# EasyEDA Pro project 智能母版V4.eprj, schematic Schematic1

## Sheets
1 电源: Create Date: 2024-02-19; Page Name: 电源; Project Name: 智能母版V4; Schematic Name: Schematic1; Update Date: 2024-07-11; Company: 嘉立创EDA; Page Size: A4; Version: V1.0
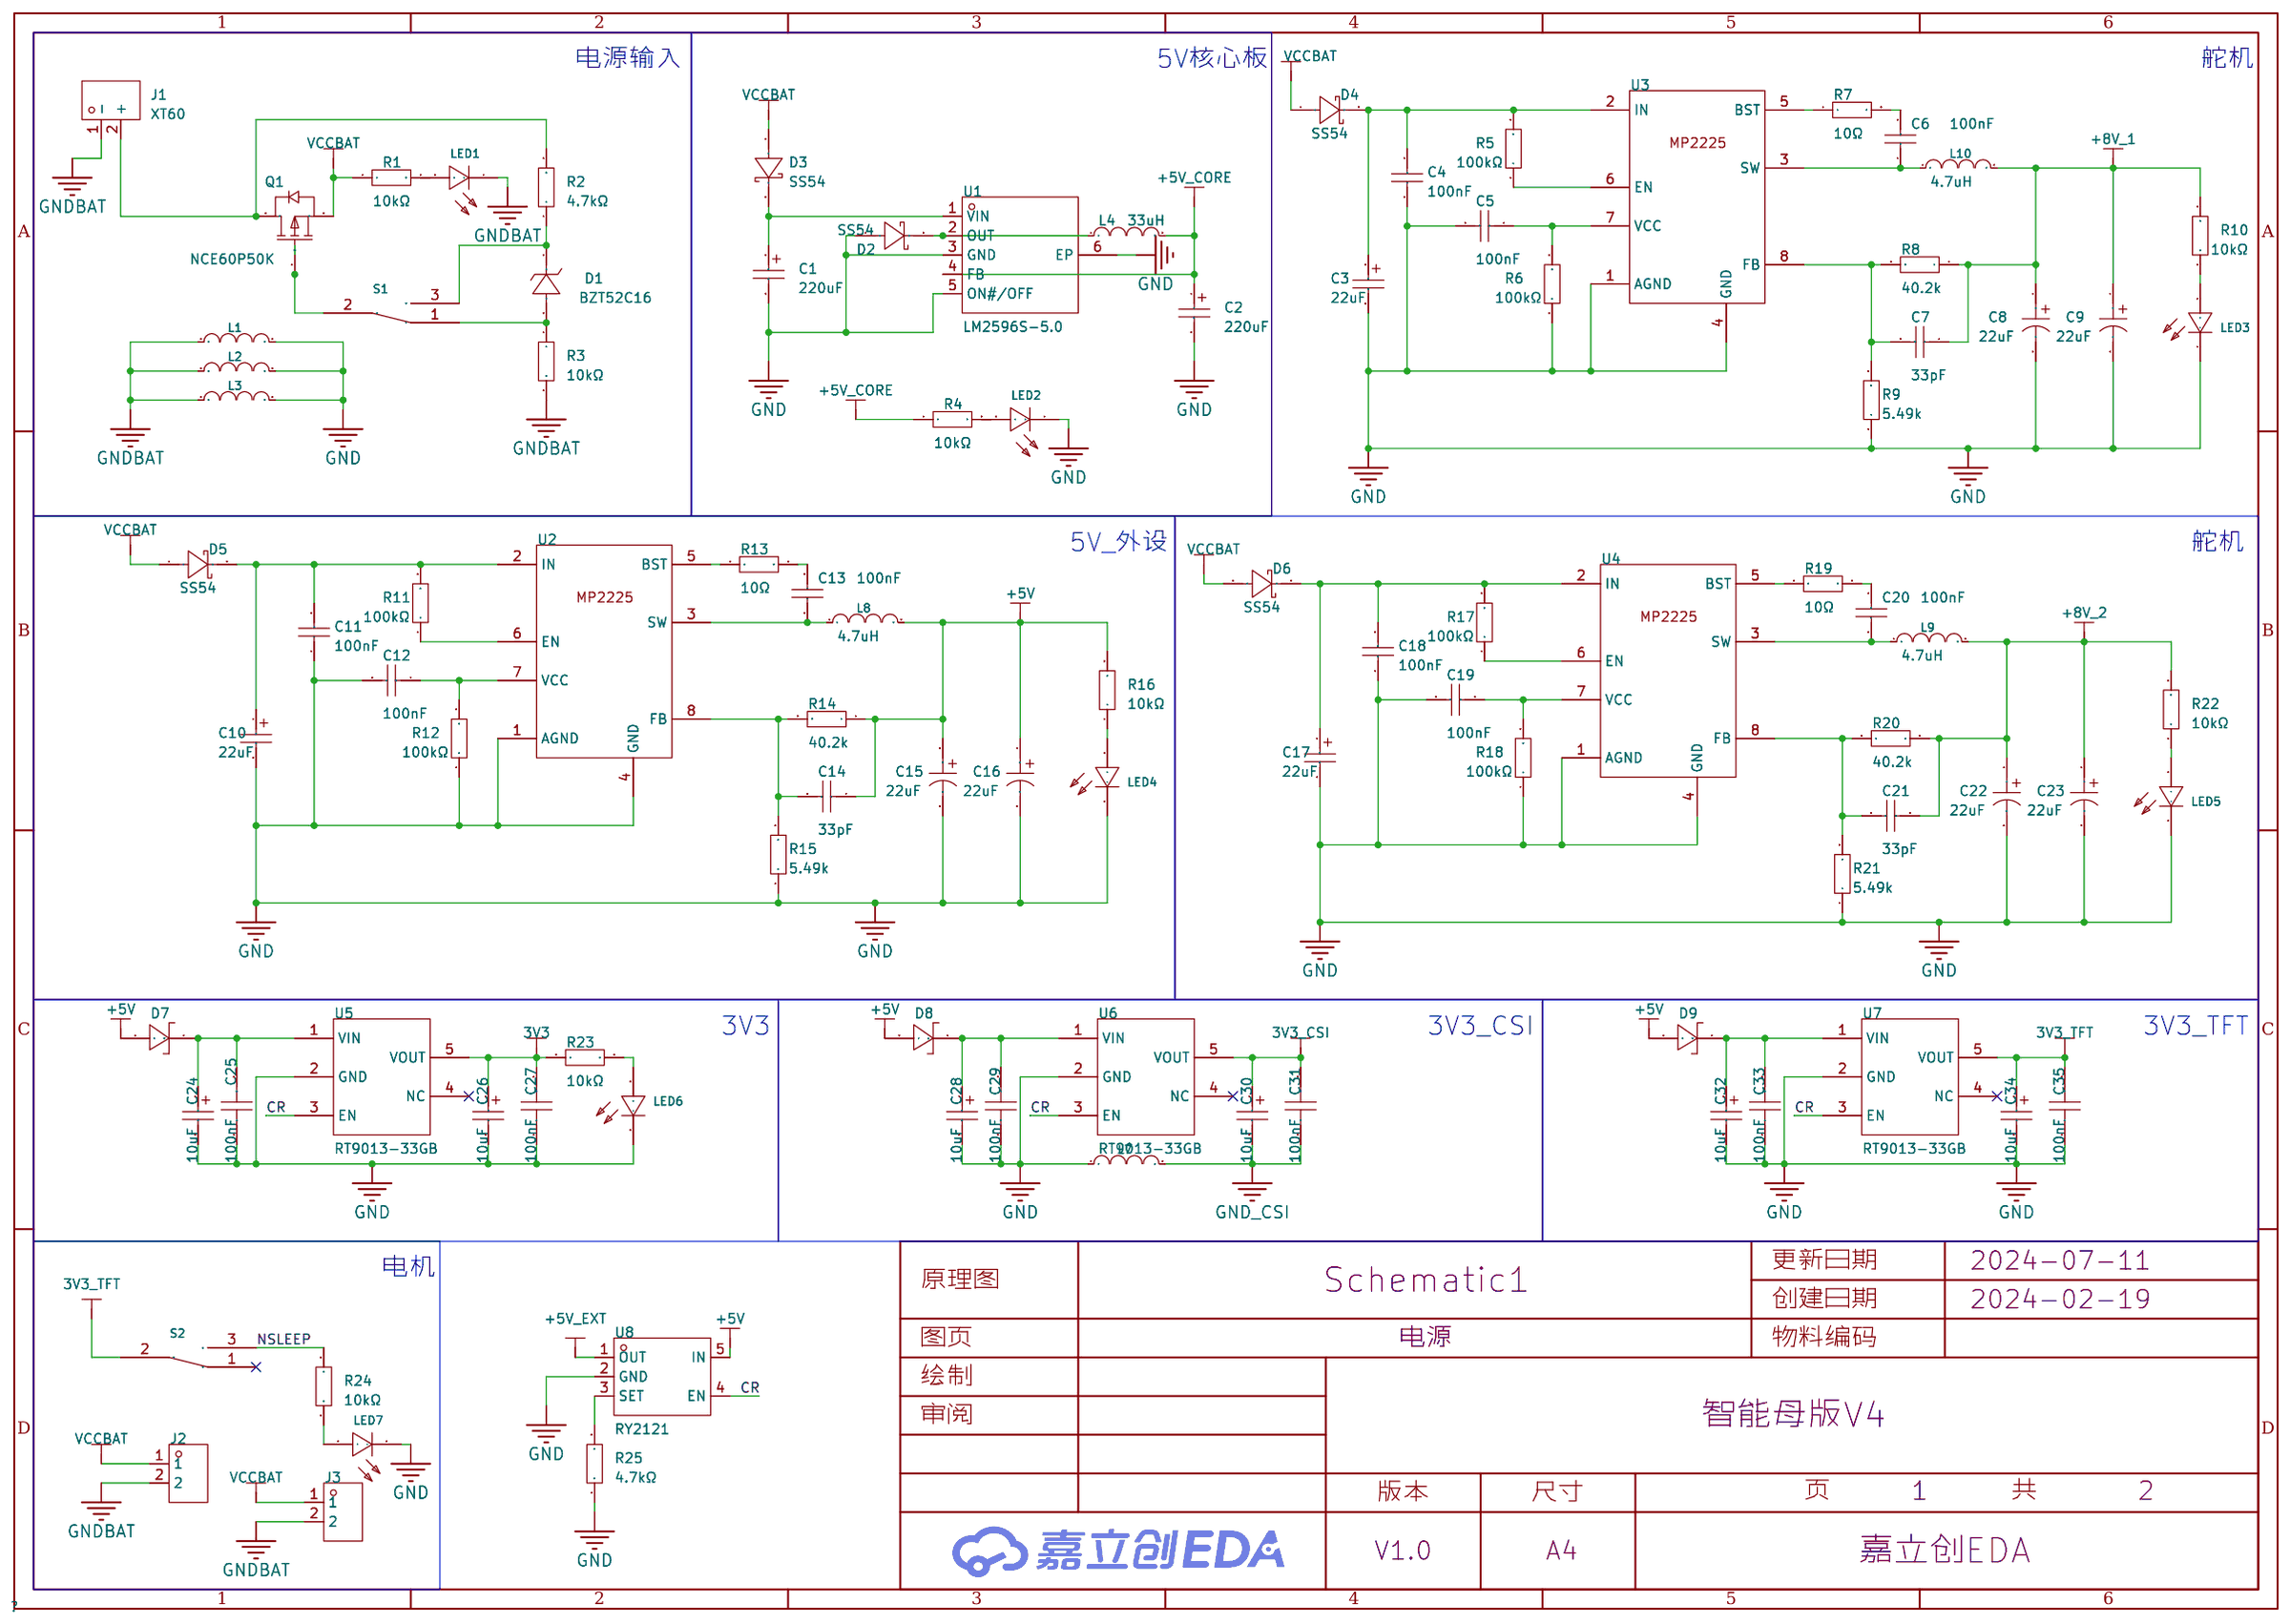
[diagram p0: 电源]
2 外设: Create Date: 2024-02-22; Page Name: 外设; Update Date: 2024-04-18
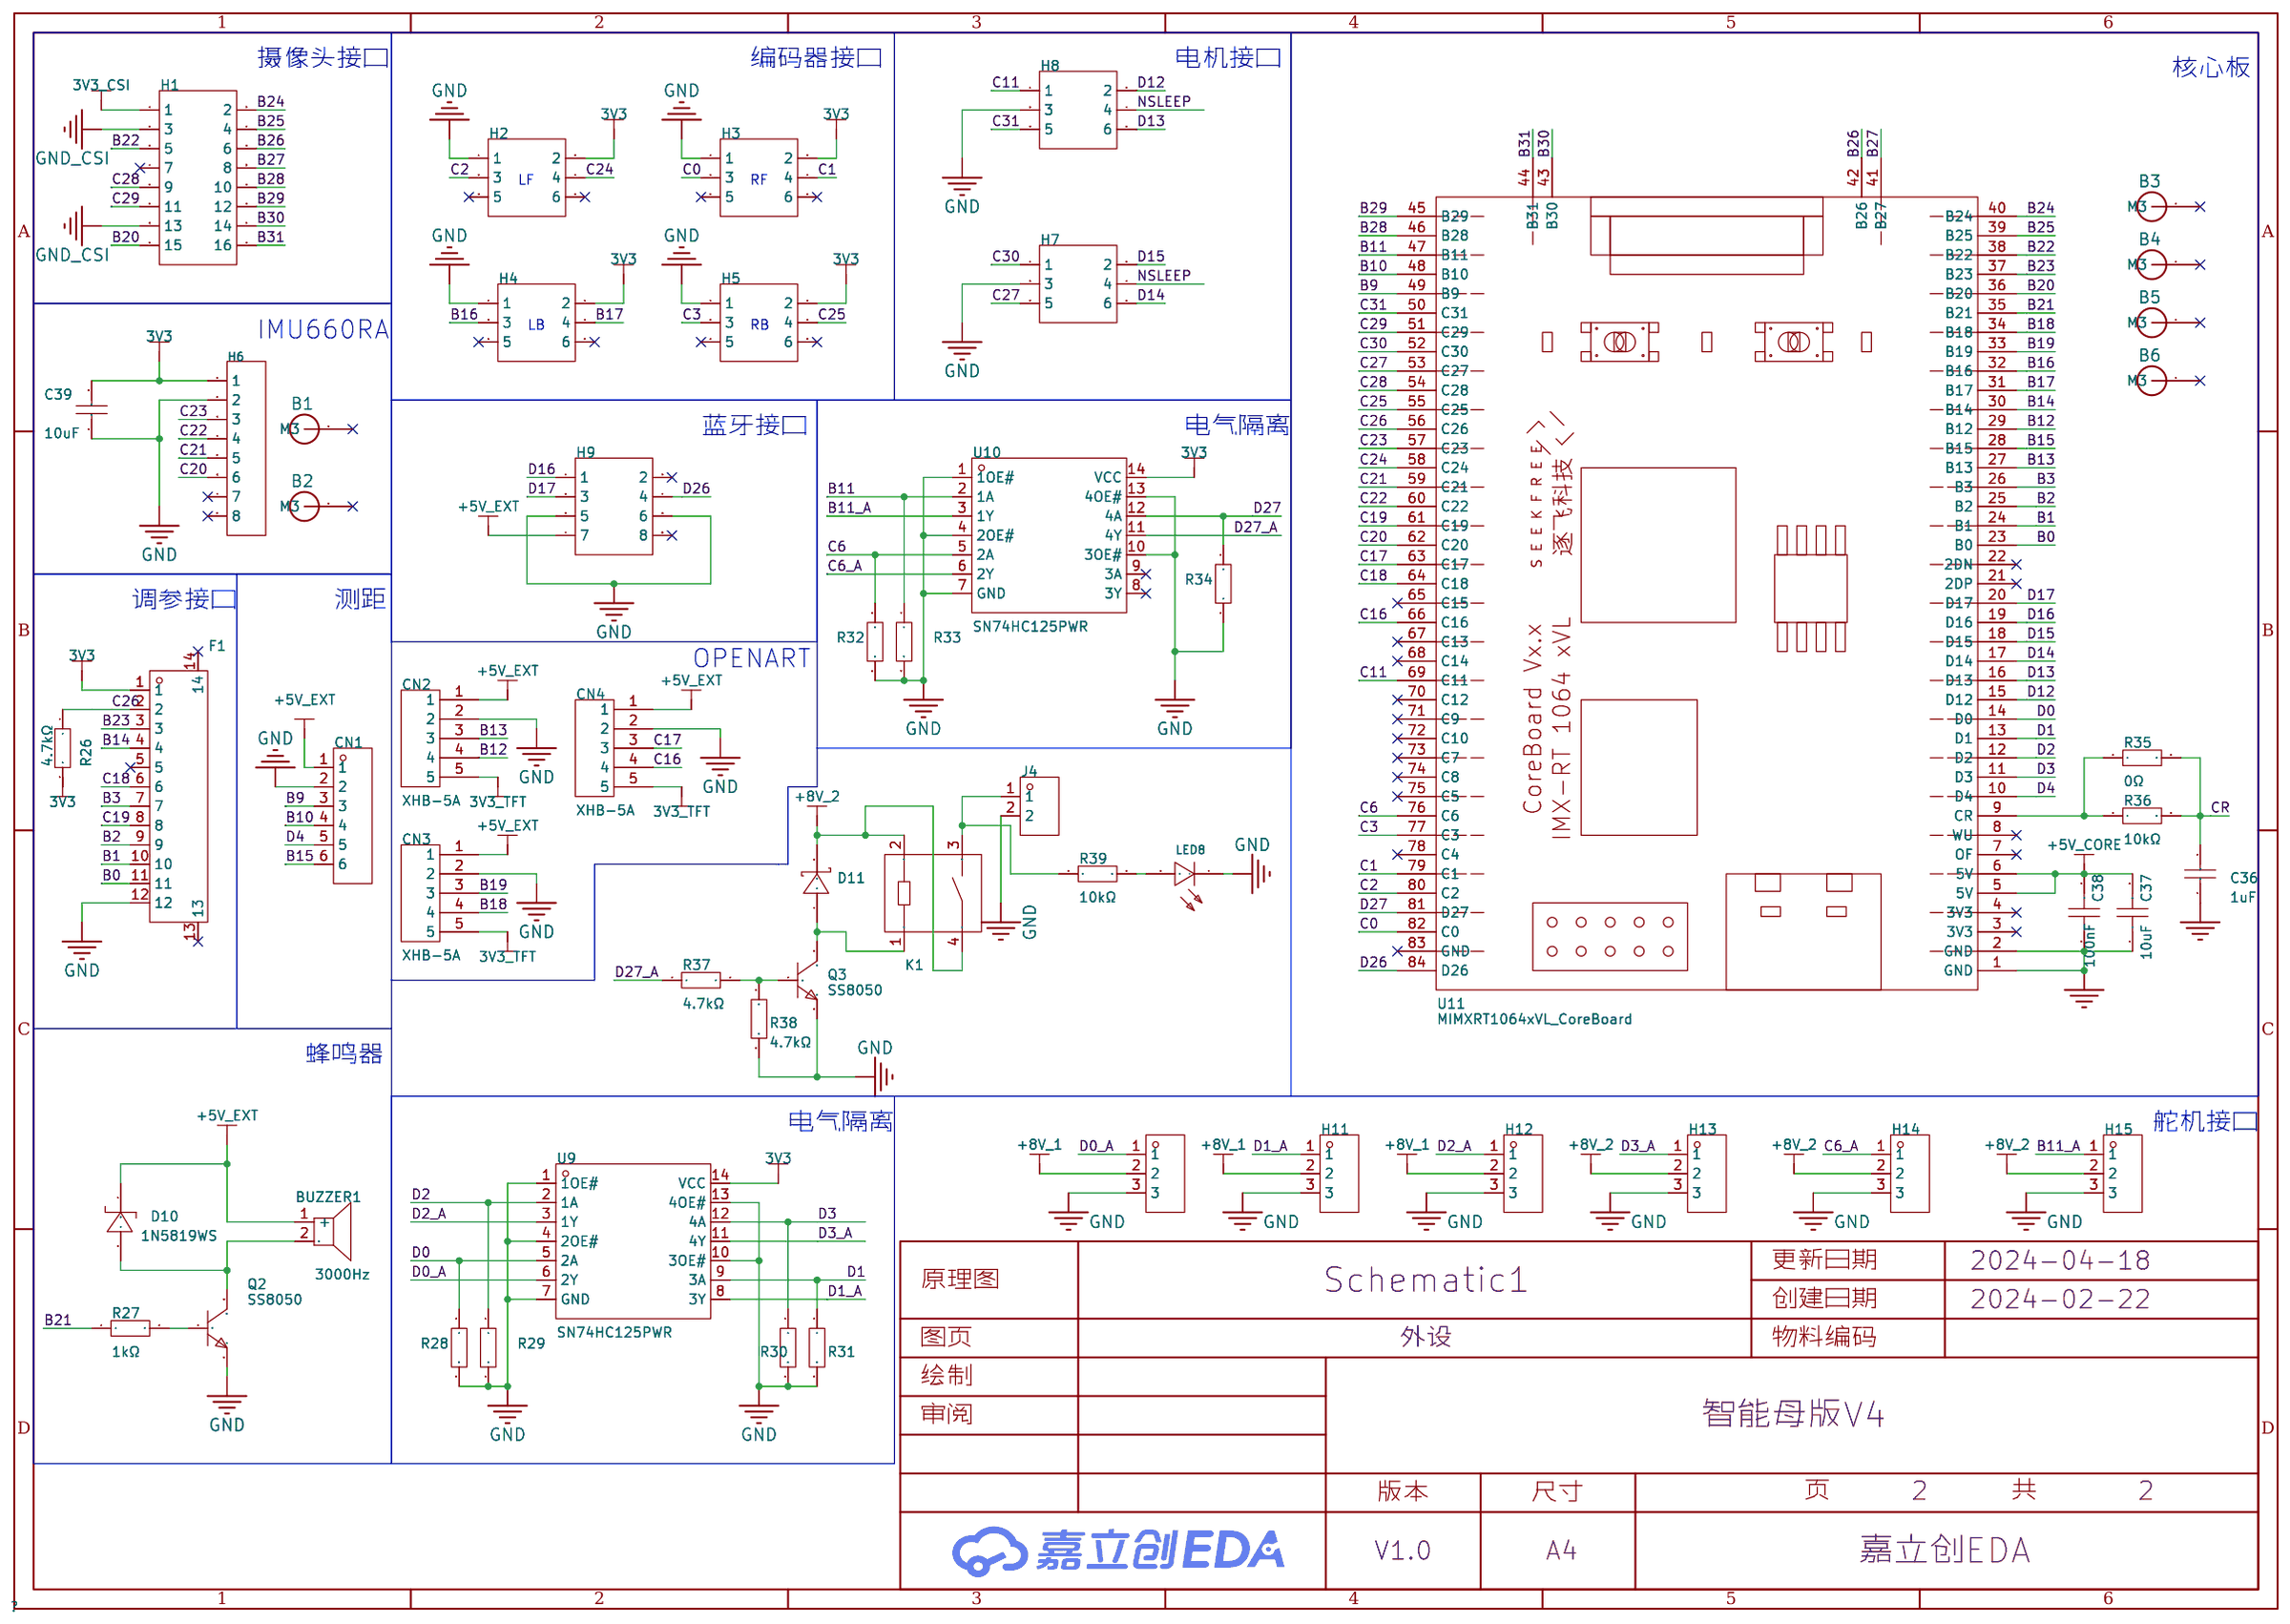
[diagram p1: 外设]

## Parts
sheet 外设
B1  M3螺柱孔_JX  [M3]
B2  M3螺柱孔_JX  [M3]
B3  M3螺柱孔_JX  [M3]
B4  M3螺柱孔_JX  [M3]
B5  M3螺柱孔_JX  [M3]
B6  M3螺柱孔_JX  [M3]
BUZZER1  3000Hz  [BUZ-TH_BD9.6-P5.00-D0.7-FD]
C36  1uF  [C0805]
C37  10uF  [C0603]
C38  100nF  [C0603]
C39  10uF  [C0805]
CN1  ZX-HA2.54-6PZZ  [CONN-TH_6P-P2.50_ZX-HA2.54-6PZZ]
CN2  XHB-5A  [XHB-TH_5PIN-V-PITCH2.50-R]
CN3  XHB-5A  [XHB-TH_5PIN-V-PITCH2.50-R]
CN4  XHB-5A  [XHB-TH_5PIN-V-PITCH2.50-R]
D10  1N5819WS  [SOD-323_L1.8-W1.3-LS2.5-RD]
D11  SS54  [SMA_L4.4-W2.8-LS5.4-R-RD]
F1  FPC-1.0FX-12PWCR-H20  [FPC-SMD_XUNPU_FPC-1.0FX-12PWCR-H20]
H1  -  [HDR-TH_16P-P2.54-V-F-R2-C8-S2.54-1]
H2  -  [HDR-TH_6P-P2.54-V-R2-C3-S2.54_A2541WV-2X3P]
H3  -  [HDR-TH_6P-P2.54-V-R2-C3-S2.54_A2541WV-2X3P]
H4  -  [HDR-TH_6P-P2.54-V-R2-C3-S2.54_A2541WV-2X3P]
H5  -  [HDR-TH_6P-P2.54-V-R2-C3-S2.54_A2541WV-2X3P]
H6  -  [HDR-TH_8P-P2.54-V-F-1]
H7  -  [HDR-TH_6P-P2.54-V-R2-C3-S2.54_A2541WV-2X3P]
H8  -  [HDR-TH_6P-P2.54-V-R2-C3-S2.54_A2541WV-2X3P]
H9  -  [HDR-TH_8P-P2.54-V-F-R2-C4-S2.54-1]
H10  -  [HDR-TH_3P-P2.54-V-M]
H11  -  [HDR-TH_3P-P2.54-V-M]
H12  -  [HDR-TH_3P-P2.54-V-M]
H13  -  [HDR-TH_3P-P2.54-V-M]
H14  -  [HDR-TH_3P-P2.54-V-M]
H15  -  [HDR-TH_3P-P2.54-V-M]
J4  KF301-5.0-2P  [CONN-TH_P5.00_KF301-5.0-2P]
K1  HF32F/012-HSL3  [RELAY-TH_HF32F-X-HXXXX-XXX]
LED8  NCD0603W1  [LED0603-RD]
Q2  SS8050  [SOT-23-3_L2.9-W1.3-P1.90-LS2.4-BR]
Q3  SS8050  [SOT-23-3_L2.9-W1.3-P1.90-LS2.4-BR]
R26  4.7kΩ  [R0603]
R27  1kΩ  [R0603]
R28  10kΩ  [R0603]
R29  10kΩ  [R0603]
R30  10kΩ  [R0603]
R31  10kΩ  [R0603]
R32  10kΩ  [R0603]
R33  10kΩ  [R0603]
R34  10kΩ  [R0603]
R35  0Ω  [R0603]
R36  10kΩ  [R0603]
R37  4.7kΩ  [R0603]
R38  4.7kΩ  [R0603]
R39  10kΩ  [R0603]
U9  SN74HC125PWR  [TSSOP-14_L5.0-W4.4-P0.65-LS6.5-BL]
U10  SN74HC125PWR  [TSSOP-14_L5.0-W4.4-P0.65-LS6.5-BL]
U11  MIMXRT1064xVL_CoreBoard  [MIMXRT1064xVL_CoreBoard - 3D]
sheet 电源
C1  220uF  [CASE-E_7343]
C2  220uF  [CASE-E_7343]
C3  22uF  [CAP-SMD_L6.0-W3.2-R-RD]
C4  100nF  [C0603]
C5  100nF  [C0603]
C6  100nF  [C0603]
C7  33pF  [C0603]
C8  22uF  [CAP-SMD_L3.2-W1.6]
C9  22uF  [CAP-SMD_L3.2-W1.6]
C10  22uF  [CAP-SMD_L6.0-W3.2-R-RD]
C11  100nF  [C0603]
C12  100nF  [C0603]
C13  100nF  [C0603]
C14  33pF  [C0603]
C15  22uF  [CAP-SMD_L3.2-W1.6]
C16  22uF  [CAP-SMD_L3.2-W1.6]
C17  22uF  [CAP-SMD_L6.0-W3.2-R-RD]
C18  100nF  [C0603]
C19  100nF  [C0603]
C20  100nF  [C0603]
C21  33pF  [C0603]
C22  22uF  [CAP-SMD_L3.2-W1.6]
C23  22uF  [CAP-SMD_L3.2-W1.6]
C24  10uF  [CASE-A_3216]
C25  100nF  [C0603]
C26  10uF  [CASE-A_3216]
C27  100nF  [C0603]
C28  10uF  [CASE-A_3216]
C29  100nF  [C0603]
C30  10uF  [CASE-A_3216]
C31  100nF  [C0603]
C32  10uF  [CASE-A_3216]
C33  100nF  [C0603]
C34  10uF  [CASE-A_3216]
C35  100nF  [C0603]
D1  BZT52C16  [SOD-123_L2.7-W1.6-LS3.7-RD]
D2  SS54  [SMA_L4.3-W2.6-LS5.0-FD]
D3  SS54  [SMA_L4.3-W2.6-LS5.0-FD]
D4  SS54  [SMA_L4.3-W2.6-LS5.0-FD]
D5  SS54  [SMA_L4.3-W2.6-LS5.0-FD]
D6  SS54  [SMA_L4.3-W2.6-LS5.0-FD]
D7  1N5819WS  [SOD-323_L1.8-W1.3-LS2.5-RD]
D8  1N5819WS  [SOD-323_L1.8-W1.3-LS2.5-RD]
D9  1N5819WS  [SOD-323_L1.8-W1.3-LS2.5-RD]
J1  XT60  [CONN-TH_XT60]
J2  KF301-5.0-2P  [CONN-TH_P5.00_KF301-5.0-2P]
J3  KF301-5.0-2P  [CONN-TH_P5.00_KF301-5.0-2P]
L1  CBG201209U000T  [L0805]
L2  CBG201209U000T  [L0805]
L3  CBG201209U000T  [L0805]
L4  33uH  [IND-SMD_L7.0-W6.6_FXL0630]
L7  CBG201209U000T  [L0805]
L8  4.7uH  [IND-SMD_L5.4-W5.2_FXL0530]
L9  4.7uH  [IND-SMD_L5.4-W5.2_FXL0530]
L10  4.7uH  [IND-SMD_L5.4-W5.2_FXL0530]
LED1  NCD0603R1  [LED0603-RD_RED]
LED2  NCD0603R1  [LED0603-RD_RED]
LED3  NCD0603W1  [LED0603-RD]
LED4  NCD0603W1  [LED0603-RD]
LED5  NCD0603W1  [LED0603-RD]
LED6  NCD0603W1  [LED0603-RD]
LED7  NCD0603W1  [LED0603-RD]
Q1  NCE60P50K  [TO-252-2_L6.6-W6.1-P4.57-LS9.9-TL-CW]
R1  10kΩ  [R0603]
R2  4.7kΩ  [R0603]
R3  10kΩ  [R0603]
R4  10kΩ  [R0603]
R5  100kΩ  [R0603]
R6  100kΩ  [R0603]
R7  10Ω  [R0603]
R8  40.2k  [R0603]
R9  5.49k  [R0603]
R10  10kΩ  [R0603]
R11  100kΩ  [R0603]
R12  100kΩ  [R0603]
R13  10Ω  [R0603]
R14  40.2k  [R0603]
R15  5.49k  [R0603]
R16  10kΩ  [R0603]
R17  100kΩ  [R0603]
R18  100kΩ  [R0603]
R19  10Ω  [R0603]
R20  40.2k  [R0603]
R21  5.49k  [R0603]
R22  10kΩ  [R0603]
R23  10kΩ  [R0603]
R24  10kΩ  [R0603]
R25  4.7kΩ  [R0603]
S1  MT-0-102-A101-M200-RS  [SW-TH_MT-0-103-A101-M200-RS]  (no BOM)
S2  MT-0-102-A101-M200-RS  [SW-TH_MT-0-103-A101-M200-RS]  (no BOM)
U1  LM2596S-5.0  [TO-263-5_L10.2-W8.9-P1.70-BR]
U2  -  [tsot-23-8_l2.9-w1.6-p0.65-ls2.8-br]
U3  -  [tsot-23-8_l2.9-w1.6-p0.65-ls2.8-br]
U4  -  [tsot-23-8_l2.9-w1.6-p0.65-ls2.8-br]
U5  RT9013-33GB  [SOT-23-5_L3.0-W1.7-P0.95-LS2.8-BL]
U6  RT9013-33GB  [SOT-23-5_L3.0-W1.7-P0.95-LS2.8-BL]
U7  RT9013-33GB  [SOT-23-5_L3.0-W1.7-P0.95-LS2.8-BL]
U8  RY2121  [SOT-23-5_L3.0-W1.6-P0.95-LS2.8-BL]

## Library data of the parts
B1-B6 = M3螺柱孔_JX
BUZZER1 = HNB09A05: 驱动方式:有源(内含驱动线路);构造类型:电磁式;额定电压:5V;工作电压:4V~8V;频率:3000Hz;声压(SPL):85dB@5V,10cm;直径(φD):9mm;高度:5.7mm;; Supplier Part: C96493; Manufacturer: 华能; Supplier Footprint: 插件; JLCPCB Part Class: 扩展库; Datasheet: https://atta.szlcsc.com/upload/public/pdf/source/20170522/1495448327549.pdf; Supplier: LCSC; Oscillator Circuit: 有源(内含驱动线路); Technology Type: 电磁式; Rated Voltage: 5V; Operating Voltage: 4V~8V; Sound Pressure Level (SPL): 85dB@5V,10cm; Diameter (φD): 9mm; Height: 5.7mm
C36 = GCM21BR71H105KA03L: 容值:1uF;精度:±10%;额定电压:50V;材质(温度系数):X7R;; LCSC Part Name: 1uF ±10% 50V; Supplier Part: C126592; Manufacturer: muRata(村田); Supplier Footprint: 0805; JLCPCB Part Class: 扩展库; Datasheet: https://atta.szlcsc.com/upload/public/pdf/source/20170912/C126592_1505207918399963689.pdf; Supplier: LCSC; Tolerance: ±10%; Voltage Rated: 50V; Temperature Coefficient: X7R
C37 = CL10A106KP8NNNC: 容值:10uF;精度:±10%;额定电压:10V;材质(温度系数):X5R;; LCSC Part Name: 10uF ±10% 10V; Supplier Part: C19702; Manufacturer: SAMSUNG(三星); Supplier Footprint: 0603; JLCPCB Part Class: 基础库; Datasheet: https://atta.szlcsc.com/upload/public/pdf/source/20160218/1457707763339.pdf; Supplier: LCSC; Tolerance: ±10%; Voltage Rated: 10V; Temperature Coefficient: X5R
C25 C27 C29 C31 C33 C35 C38 = CAP_0603: Supplier Footprint: 0603
C39 = CL21A106KAYNNNE_C15850: 容值:10uF;精度:±10%;额定电压:25V;材质(温度系数):X5R;; LCSC Part Name: 10uF ±10% 25V; Supplier Part: C15850; Manufacturer: SAMSUNG(三星); Manufacturer Part: CL21A106KAYNNNE; Supplier Footprint: 0805; JLCPCB Part Class: 基础库; Datasheet: https://atta.szlcsc.com/upload/public/pdf/source/20160103/1457707679302.pdf; Supplier: LCSC; Tolerance: ±10%; Voltage Rated: 25V; Temperature Coefficient: X5R
CN1 = ZX-HA2.54-6PZZ: 插针结构:1x6P;间距:2.54mm;安装方式:直插;参考系列:XH;总PIN数:6P;排数:1;每排PIN数:6;行距:-;额定电流:3A;触头材质:黄铜;触头镀层:锡;工作温度范围:-25℃~+85℃;; LCSC Part Name: 1x6P 间距:2.54mm 直插 系列:XH/HA带扣; Supplier Part: C7429618; Manufacturer: Megastar(兆星); Supplier Footprint: 插件,P=2.54mm; JLCPCB Part Class: 扩展库; Datasheet: https://atta.szlcsc.com/upload/public/pdf/source/20230619/9741958357BE16A00186B372434A49B2.pdf; Supplier: LCSC; Pins Structure: 1x6P; Pitch: 2.54mm; Mounting Style: 直插; Reference Series: XH; Number of Pins: 6P; Number of Rows: 1; Number of PINs Per Row: 6; Current Rating (Max): 3A; Contact Material: 黄铜; Contact Plating: 锡; Operating Temperature Range: -25℃~+85℃
CN2-CN4 = XHB-5A: 插针结构:1x5P;间距:2.5mm;安装方式:-;参考系列:-;总PIN数:5P;排数:1;每排PIN数:5;行距:-;触头材质:-;; LCSC Part Name: 间距:2.5mm 1x5P; Supplier Part: C66559; Manufacturer: BOOMELE(博穆精密); Supplier Footprint: 插件,P=2.5mm; JLCPCB Part Class: 扩展库; Datasheet: https://atta.szlcsc.com/upload/public/pdf/source/20180809/C95477_BD1018113A27F451D6913E683B76B7C4.pdf; Supplier: LCSC; Pins Structure: 1x5P; Pitch: 2.5mm; Number of Pins: 5P; Number of Rows: 1; Number of PINs Per Row: 5
D7-D10 = 1N5819WS_C191023: 直流反向耐压(Vr):40V;平均整流电流(Io):1A;正向压降(Vf):600mV@1A;; LCSC Part Name: 40V 1A 600mV@1A; Supplier Part: C191023; Manufacturer: Hottech(合科泰); Supplier Footprint: SOD-323; JLCPCB Part Class: 基础库; Datasheet: https://atta.szlcsc.com/upload/public/pdf/source/20220428/3CB86FD8D28D653594B4E35F9D5AEFD9.pdf; Supplier: LCSC; Reverse Voltage (Vr): 40V; Average Rectified Current (Io): 1A; Forward Voltage (Vf@If): 600mV@1A
D11 = SS54_C22452: 正向压降(Vf):550mV@5A;直流反向耐压(Vr):40V;平均整流电流(Io):5A;; LCSC Part Name: 电压:40V 电流:5A; Supplier Part: C22452; Manufacturer: MDD; Supplier Footprint: SMA(DO-214AC); JLCPCB Part Class: 基础库; Datasheet: https://atta.szlcsc.com/upload/public/pdf/source/20230314/529CD85F9B31F69841D3A079BC07E377.pdf; Supplier: LCSC; Forward Voltage (Vf@If): 550mV@5A; Reverse Voltage (Vr): 40V; Average Rectified Current (Io): 5A; Reverse Leakage Current (Ir): 1mA@40V
F1 = FPC-1.0FX-12PWCR-H20: 锁定特性:翻盖式;触点类型:下接;触点数量:12P;间距:1mm;安装类型:卧贴;; LCSC Part Name: 间距:1mm P数:12P 翻盖式 下接; Supplier Part: C19269355; Manufacturer: XUNPU(讯普); Supplier Footprint: SMD,P=1mm,卧贴; Datasheet: https://atta.szlcsc.com/upload/public/pdf/source/20231121/46D1D420E162B395A0FFF09C3BB98E72.pdf; Supplier: LCSC; Locking Feature: 翻盖式; Contact Type: 下接; Number of Contacts: 12P; Pitch: 1mm; Mounting Type: 卧贴; Height Above Board: 2mm
H1 = HDR-F_2.54_2x8: Supplier Part: C30734; Supplier Footprint: 插件
H2-H5 H7 H8 = HDR-M_2.54_2x3: Supplier Part: C402781; Supplier Footprint: 插件,P=2.54mm
H6 = HDR-F_2.54_1x8P: Supplier Part: C27438; Supplier Footprint: 插件
H9 = HDR-F_2.54_2x4: Supplier Part: C92271; Supplier Footprint: 插件
H10-H15 = HDR-M_2.54_1x3P: Supplier Part: C2937625; Supplier Footprint: 插件
J2-J4 = KF301-5.0-2P: 间距:5mm;排数:1;每排PIN数:2;安装方式:直针;额定电流:17A;额定电压:250V;线规 - AWG:14~22;线规 - mm?:1.5;工作温度范围:-30℃~+120℃;颜色:蓝色;; LCSC Part Name: 5mm 排数:1 每排P数:2 直针 可拼接 铜 环保; Supplier Part: C474881; Manufacturer: KEFA(科发); Supplier Footprint: 直插,P=5mm; JLCPCB Part Class: Extended Part; Datasheet: https://atta.szlcsc.com/upload/public/pdf/source/20200115/C474881_883EFE2003339C40FD1BEEEFC9A18423.pdf; Supplier: LCSC; Pitch: 5mm; Number of Rows: 1; Number of PINs Per Row: 2; Mounting Style: 直针; Current Rating (Max): 17A; Voltage Rating (Max): 250V; Wire Gauge - AWG: 14~22; Wire Gauge - mm?: 1.5; Operating Temperature Range: -30℃~+120℃; Color: 蓝色
K1 = HF32F/012-HSL3: 线圈电压:12V;触点形式:一组常开:1A(单刀单掷-常开);触点容量(电阻负载):3A@30VDC；3A@250VAC;最大切换电压:250V@AC；30V@DC;最大切换电流:10A;; LCSC Part Name: 超小型中功率12V继电器 单刀单掷-常开; Supplier Part: C3008307; Manufacturer: HF(宏发); Supplier Footprint: 插件,10.2x18.4mm; JLCPCB Part Class: 扩展库; Datasheet: https://atta.szlcsc.com/upload/public/pdf/source/20181114/C329304_627EE54CA46654A4F58CCC8060C61A12.pdf; Supplier: LCSC; Coil Voltage: 12V; Contact Form: 一组常开:1A(单刀单掷-常开); Pin Number: 4; Contact Rating: 3A@30VDC；3A@250VAC; Maximum Switching Voltage: 250V@AC；30V@DC; Coil Rated Power: 200mW; Contact Material: AgNi; Maximum Switching Current: 10A; Coil Type: 无极性-单线圈; Coil Resistance: 720Ω; Contact Resistance: 100mΩ; Operate Time: 8ms; Release Time: 5ms; Operating Temperature: -40℃~+70℃
LED3-LED8 = NCD0603W1: 发光颜色:白灯;; LCSC Part Name: 白灯 0603白灯   正贴; Supplier Part: C84265; Manufacturer: 国星光电; Supplier Footprint: 0603; JLCPCB Part Class: Extended Part; Datasheet: https://atta.szlcsc.com/upload/public/pdf/source/20200820/C84265_479E6193713348A548E5CD6D9278BF16.pdf; Supplier: LCSC; Emitted Color: 白灯
Q2 = SS8050_C2150: 晶体管类型:NPN;集射极击穿电压(Vceo):25V;集电极电流(Ic):1.5A;功率(Pd):300mW;直流电流增益(hFE@Ic,Vce):200@100mA,1V;; LCSC Part Name: NPN 25V 1.5A Y1 200-350; Supplier Part: C2150; Manufacturer: CJ(江苏长电/长晶); Supplier Footprint: SOT-23; JLCPCB Part Class: 基础库; Datasheet: https://atta.szlcsc.com/upload/public/pdf/source/20230322/AEE86F4B043774EFF80CAEA14A37D9E9.pdf; Supplier: LCSC; Transistor Type: NPN; Collector-Emitter Breakdown Voltage (Vceo): 25V; Collector Current (Ic): 1.5A; Power Dissipation (Pd): 300mW; Collector Cut-Off Current (Icbo): 100nA; Collector-Emitter Saturation Voltage (VCE(sat)@Ic,Ib): 500mV@800mA,80mA; DC Current Gain (hFE@Ic,Vce): 200@100mA,1V; Transition Frequency (fT): 100MHz; Operating Temperature: +150℃@(Tj)
Q3 = SS8050_C2150: 晶体管类型:NPN;集电极电流(Ic):1.5A;集射极击穿电压(Vceo):25V;功率(Pd):300mW;直流电流增益(hFE@Ic,Vce):200@100mA,1V;; LCSC Part Name: NPN 电流:1.5A 耐压:25V hfe=200~350; Supplier Part: C2150; Manufacturer: CJ(江苏长电/长晶); Supplier Footprint: SOT-23; JLCPCB Part Class: 基础库; Datasheet: https://atta.szlcsc.com/upload/public/pdf/source/20230322/AEE86F4B043774EFF80CAEA14A37D9E9.pdf; Supplier: LCSC; Transistor Type: NPN; Collector-Emitter Breakdown Voltage (Vceo): 25V; Collector Current (Ic): 1.5A; Power Dissipation (Pd): 300mW; Collector Cut-Off Current (Icbo): 100nA; Collector-Emitter Saturation Voltage (VCE(sat)@Ic,Ib): 500mV@800mA,80mA; DC Current Gain (hFE@Ic,Vce): 200@100mA,1V; Transition Frequency (fT): 100MHz
R1 R3 R4 R10 R16 R22-R26 R28-R34 R39 = 0603WAF1002T5E: 电阻类型:厚膜电阻;阻值:10kΩ;精度:±1%;功率:100mW;; LCSC Part Name: 厚膜电阻 10kΩ ±1% 100mW; Supplier Part: C25804; Manufacturer: UNI-ROYAL(厚声); Supplier Footprint: 0603; JLCPCB Part Class: 基础库; Datasheet: https://atta.szlcsc.com/upload/public/pdf/source/20200306/C422600_1E6D84923E4A46A82E41ADD87F860B5C.pdf; Supplier: LCSC; Type: 厚膜电阻; Tolerance: ±1%; Power(Watts): 100mW; Temperature Coefficient: ±100ppm/℃; Overload Voltage (Max): 75V; Operating Temperature Range: -55℃~+155℃
R27 = 0603WAF1001T5E: 电阻类型:厚膜电阻;阻值:1kΩ;精度:±1%;功率:100mW;; LCSC Part Name: 1kΩ ±1% 100mW; Supplier Part: C21190; Manufacturer: UNI-ROYAL(厚声); Supplier Footprint: 0603; JLCPCB Part Class: Basic Part; Datasheet: https://atta.szlcsc.com/upload/public/pdf/source/20200306/C422600_1E6D84923E4A46A82E41ADD87F860B5C.pdf; Supplier: LCSC; Type: 厚膜电阻; Tolerance: ±1%; Power(Watts): 100mW; Temperature Coefficient: ±100ppm/℃; Overload Voltage (Max): 75V; Operating Temperature Range: -55℃~+155℃
R35 = RC0603FR-070RL: 电阻类型:厚膜电阻;阻值:0Ω;精度:±1%;功率:100mW;最大工作电压:75V;温度系数:-;; LCSC Part Name: 厚膜电阻 0Ω ±1% 100mW; Supplier Part: C100044; Manufacturer: YAGEO(国巨); Supplier Footprint: 0603; JLCPCB Part Class: 扩展库; Datasheet: https://atta.szlcsc.com/upload/public/pdf/source/20180316/70C0E2BDAE7FCC62C531A5A58D202EE1.pdf; Supplier: LCSC; Type: 厚膜电阻; Tolerance: ±1%; Power(Watts): 100mW; Overload Voltage (Max): 75V; Operating Temperature Range: -55℃~+155℃
R36 = RT0603BRD0710KL: 电阻类型:薄膜电阻;阻值:10kΩ;精度:±0.1%;功率:100mW;最大工作电压:75V;温度系数:±25ppm/℃;; LCSC Part Name: 薄膜电阻 10kΩ ±0.1% 100mW; Supplier Part: C95204; Manufacturer: YAGEO(国巨); Supplier Footprint: 0603; JLCPCB Part Class: 扩展库; Datasheet: https://atta.szlcsc.com/upload/public/pdf/source/20170217/1487301593756.pdf; Supplier: LCSC; Type: 薄膜电阻; Tolerance: ±0.1%; Power(Watts): 100mW; Overload Voltage (Max): 75V; Temperature Coefficient: ±25ppm/℃; Operating Temperature Range: -55℃~+155℃
R37 R38 = RC0603FR-074K7L: 电阻类型:厚膜电阻;阻值:4.7kΩ;精度:±1%;功率:100mW;最大工作电压:75V;温度系数:±100ppm/℃;; LCSC Part Name: 厚膜电阻 4.7kΩ ±1% 100mW; Supplier Part: C99782; Manufacturer: YAGEO(国巨); Supplier Footprint: 0603; JLCPCB Part Class: 扩展库; Datasheet: https://atta.szlcsc.com/upload/public/pdf/source/20180224/C181757_15194369480721363983.pdf; Supplier: LCSC; Type: 厚膜电阻; Tolerance: ±1%; Power(Watts): 100mW; Overload Voltage (Max): 75V; Temperature Coefficient: ±100ppm/℃; Operating Temperature Range: -55℃~+155℃
U9 U10 = SN74HC125PWR: 类型:缓冲器，非反相;电源电压:2V~6V;输入类型:-;输出类型:三态;低电平输出电流(IOL):7.8mA;高电平输出电流(IOH):7.8mA;工作温度:-40℃~+85℃;; Supplier Part: C132994; Manufacturer: TI(德州仪器); Supplier Footprint: TSSOP-14; JLCPCB Part Class: Extended Part; Datasheet: https://atta.szlcsc.com/upload/public/pdf/source/20170930/C132994_1506736365150997346.pdf; Supplier: LCSC; Type: 缓冲器，非反相; Supply Voltage: 2V~6V; output type: 三态; Current-OutputLow: 7.8mA; Current-OutputHigh: 7.8mA; Operating temperature: -40℃~+85℃
U11 = MIMXRT1064xVL_CoreBoard
C1 C2 = TAJE227K016RNJ: 容值:220uF;精度:±10%;额定电压:16V;等效串联电阻:500mΩ@100kHz;; LCSC Part Name: 220uF ±10% 16V; Supplier Part: C7231; Manufacturer: Kyocera AVX; Supplier Footprint: CASE-E-7343; JLCPCB Part Class: 扩展库; Datasheet: https://atta.szlcsc.com/upload/public/pdf/source/20160107/1457707750344.pdf; Supplier: LCSC; Tolerance: ±10%; Rated Voltage: 16V; Equivalent Series Resistance(ESR): 500mΩ@100kHz; Operating Temperature: -55℃~+125℃
C3 C10 C17 = TAJC226K025RNJ: 容值:22uF;精度:±10%;额定电压:25V;等效串联电阻:1.4Ω@100kHz;; LCSC Part Name: 22uF ±10% 25V; Supplier Part: C7214; Manufacturer: Kyocera AVX; Supplier Footprint: CASE-C-6032; JLCPCB Part Class: Extended Part; Datasheet: https://atta.szlcsc.com/upload/public/pdf/source/20160107/1457707749198.pdf; Supplier: LCSC; Tolerance: ±10%; Rated Voltage: 25V; Equivalent Series Resistance(ESR): 1.4Ω@100kHz; Operating Temperature: -55℃~+125℃
C4-C6 C11-C13 C18-C20 = 0603B104K500NT: 容值:100nF;精度:±10%;额定电压:50V;材质(温度系数):X7R;; LCSC Part Name: 100nF ±10% 50V; Supplier Part: C30926; Manufacturer: FH(风华); Supplier Footprint: 0603; JLCPCB Part Class: Extended Part; Datasheet: https://atta.szlcsc.com/upload/public/pdf/source/20170923/C30926_1506149436298988724.pdf; Supplier: LCSC; Tolerance: ±10%; Voltage Rated: 50V; Temperature Coefficient: X7R
C7 C14 C21 = CL10C330JB8NNNC: 容值:33pF;精度:±5%;额定电压:50V;材质(温度系数):C0G;; LCSC Part Name: 33pF ±5% 50V; Supplier Part: C1663; Manufacturer: SAMSUNG(三星); Supplier Footprint: 0603; JLCPCB Part Class: 基础库; Datasheet: https://atta.szlcsc.com/upload/public/pdf/source/20160103/1457707688366.pdf; Supplier: LCSC; Tolerance: ±5%; Voltage Rated: 50V; Temperature Coefficient: C0G
C8 C9 C15 C16 C22 C23 = CA45-A-16V-22uF-K: 容值:22uF;精度:±10%;额定电压:16V;等效串联电阻:6Ω@100kHz;; LCSC Part Name: 22uF ±10% 16V; Supplier Part: C782264; Manufacturer: CEC(振华新云); Supplier Footprint: CASE-A-3216; JLCPCB Part Class: Extended Part; Datasheet: https://atta.szlcsc.com/upload/public/pdf/source/20200909/C782264_D6D9C4EF3B25E81633C26A9294FBB820.pdf; Supplier: LCSC; Tolerance: ±10%; Rated Voltage: 16V; Equivalent Series Resistance(ESR): 6Ω@100kHz; Operating Temperature: -55℃~+125℃
C24 C26 C28 C30 C32 C34 = CA45-A-10V-10uF-M: 容值:10uF;精度:±20%;额定电压:10V;等效串联电阻:8Ω@100kHz;工作温度:-55~+125;; LCSC Part Name: 10uF ±20% 10V; Supplier Part: C128256; Manufacturer: CEC(振华新云); JLCPCB Part Class: Extended Part; Datasheet: https://atta.szlcsc.com/upload/public/pdf/source/20171113/C128256_15105610660201115413.pdf; Supplier: LCSC; Tolerance: ±20%; Rated Voltage: 10V; Equivalent Series Resistance(ESR): 8Ω@100kHz; Operating Temperature: -55~+125
D1 = BZT52C16: 稳压值(标称值):-;精度:-;功率:500mW;反向电流(Ir):100nA@11.2V;; LCSC Part Name: 500mW; Supplier Part: C707145; Manufacturer: Slkor(萨科微); Supplier Footprint: SOD-123; JLCPCB Part Class: 扩展库; Datasheet: https://atta.szlcsc.com/upload/public/pdf/source/20200721/C707125_BAEA70ACC1B0F60BBAC1FD71D8806D24.pdf; Supplier: LCSC; Power Dissipation: 500mW; Reverse Leakage Current (Ir): 100nA@11.2V
D2-D6 = SS54_C7420369: 二极管配置:独立式;正向压降(Vf):550mV@5.0A;直流反向耐压(Vr):40V;平均整流电流(Io):5A;; LCSC Part Name: 电压:40V 电流:5A; Supplier Part: C7420369; Manufacturer: 宏迦橙; Supplier Footprint: SMA(DO-214AC); JLCPCB Part Class: 扩展库; Datasheet: https://atta.szlcsc.com/upload/public/pdf/source/20230828/254C3882F8647358AD9F60DD73611B5E.pdf; Supplier: LCSC; Diode Configuration: 独立式; Forward Voltage (Vf@If): 550mV@5.0A; Reverse Voltage (Vr): 40V; Average Rectified Current (Io): 5A; Reverse Leakage Current (Ir): 50uA@40V; Peak forward surge current: 120A
J1 = XT60: 类别:-;类型1:-;; LCSC Part Name: AMASS(艾迈斯) XT60模型插头 3.5mm镀金香蕉头公头（电调端）XT60-M; Supplier Part: C98733; Manufacturer: AMASS(艾迈斯); JLCPCB Part Class: 扩展库; Datasheet: https://atta.szlcsc.com/upload/public/pdf/source/20170606/1496716524919.pdf; Supplier: LCSC; Brand: 艾迈斯; Type: 香蕉头; Colour: 黄色; InterfaceType: 公头; specifications: 3.5mm
L1-L3 L7 = CBG201209U000T: 标称阻抗@测试频率:0Ω@100MHz;直流电阻(RDC):80mΩ;; LCSC Part Name: 单路 0805磁珠 阻抗0Ω@100MHz; Supplier Part: C91037; Manufacturer: FH(风华); Supplier Footprint: 0805; JLCPCB Part Class: 扩展库; Datasheet: https://atta.szlcsc.com/upload/public/pdf/source/20161217/1481939213023.pdf; Supplier: LCSC; Impedance @ Frequency: 0Ω@100MHz; DC Resistance: 80mΩ; Current Rating: 900mA; Circuits: 1
L4 = FXL0630-330-M: 电感值:33uH;精度:±20%;额定电流:2A;饱和电流(Isat):2.5A;类型:一体成型电感;; LCSC Part Name: 33uH ±20% 2.5A; Supplier Part: C177245; Manufacturer: cjiang(长江微电); Supplier Footprint: SMD,6.6x7mm; JLCPCB Part Class: 扩展库; Datasheet: https://atta.szlcsc.com/upload/public/pdf/source/20230516/3A080F5AF8C87BB81C3BA86E5F60E51A.pdf; Supplier: LCSC; Tolerance: ±20%; Rated Current: 2A; Saturation Current (Isat): 2.5A; DC Resistance (DCR): 310mΩ; Type: 一体成型电感
L8-L10 = FXL0530-4R7-M: 电感值:4.7uH;精度:±20%;额定电流:4.5A;饱和电流(Isat):5A;; LCSC Part Name: 4.7uH ±20% 4.5A 50mΩ; Supplier Part: C177246; Manufacturer: cjiang(长江微电); Supplier Footprint: SMD,5.4x5.2x2.8mm; JLCPCB Part Class: Extended Part; Supplier: LCSC; Tolerance: ±20%; Rated Current: 4.5A; Saturation Current (Isat): 5A; DC Resistance (DCR): 50mΩ
LED1 LED2 = NCD0603R1_C84263: 发光颜色:红灯;; LCSC Part Name: 红灯 0603红灯   正贴; Supplier Part: C84263; Manufacturer: 国星光电; Supplier Footprint: 0603; JLCPCB Part Class: Extended Part; Datasheet: https://atta.szlcsc.com/upload/public/pdf/source/20200820/C84263_DABC6A75E58F576973B407FDBA283D60.pdf; Supplier: LCSC; Emitted Color: 红灯
Q1 = NCE60P50K: 类型:P沟道;漏源电压(Vdss):60V;连续漏极电流(Id):50A;功率(Pd):95W;导通电阻(RDS(on)@Vgs,Id):23mΩ@10V,20A;阈值电压(Vgs(th)@Id):3.5V@250uA;; LCSC Part Name: P沟道 60V 50A; Supplier Part: C130104; Manufacturer: NCE(无锡新洁能); Supplier Footprint: TO-252-2(DPAK); JLCPCB Part Class: 扩展库; Datasheet: https://atta.szlcsc.com/upload/public/pdf/source/20170919/C130104_1505787180031976877.pdf; Supplier: LCSC; Type: P沟道; Drain Source Voltage (Vdss): 60V; Continuous Drain Current (Id): 50A; Power Dissipation (Pd): 95W; Drain Source On Resistance (RDS(on)@Vgs,Id): 23mΩ@10V,20A; Gate Threshold Voltage (Vgs(th)@Id): 3.5V@250uA
R2 = 0603WAF4701T5E: 电阻类型:厚膜电阻;阻值:4.7kΩ;精度:±1%;功率:100mW;; LCSC Part Name: 4.7kΩ ±1% 100mW; Supplier Part: C23162; Manufacturer: UNI-ROYAL(厚声); Supplier Footprint: 0603; JLCPCB Part Class: Basic Part; Datasheet: https://atta.szlcsc.com/upload/public/pdf/source/20200306/C422600_1E6D84923E4A46A82E41ADD87F860B5C.pdf; Supplier: LCSC; Type: 厚膜电阻; Tolerance: ±1%; Power(Watts): 100mW; Temperature Coefficient: ±100ppm/℃; Overload Voltage (Max): 75V; Operating Temperature Range: -55℃~+155℃
R5 R6 R11 R12 R17 R18 = RC0603FR-07100KL: 电阻类型:厚膜电阻;阻值:100kΩ;精度:±1%;功率:100mW;; LCSC Part Name: 100kΩ ±1% 100mW; Supplier Part: C14675; Manufacturer: YAGEO(国巨); Supplier Footprint: 0603; JLCPCB Part Class: Extended Part; Datasheet: https://atta.szlcsc.com/upload/public/pdf/source/20140324/1457707028752.pdf; Supplier: LCSC; Type: 厚膜电阻; Tolerance: ±1%; Power(Watts): 100mW; Temperature Coefficient: ±100ppm/℃; Overload Voltage (Max): 75V; Operating Temperature Range: -55℃~+155℃
R7 R13 R19 = 0603WAF100JT5E: 电阻类型:厚膜电阻;阻值:10Ω;精度:±1%;功率:100mW;; LCSC Part Name: 10Ω ±1% 100mW; Supplier Part: C22859; Manufacturer: UNI-ROYAL(厚声); Supplier Footprint: 0603; JLCPCB Part Class: Basic Part; Datasheet: https://atta.szlcsc.com/upload/public/pdf/source/20200306/C422600_1E6D84923E4A46A82E41ADD87F860B5C.pdf; Supplier: LCSC; Type: 厚膜电阻; Tolerance: ±1%; Power(Watts): 100mW; Temperature Coefficient: ±400ppm/℃; Overload Voltage (Max): 75V; Operating Temperature Range: -55℃~+155℃
R8 R14 R20 = 0603WAF4022T5E: 电阻类型:厚膜电阻;阻值:40.2kΩ;精度:±1%;功率:100mW;; LCSC Part Name: 40.2kΩ ±1% 100mW; Supplier Part: C12447; Manufacturer: UNI-ROYAL(厚声); Supplier Footprint: 0603; JLCPCB Part Class: Basic Part; Datasheet: https://atta.szlcsc.com/upload/public/pdf/source/20200306/C422600_1E6D84923E4A46A82E41ADD87F860B5C.pdf; Supplier: LCSC; Type: 厚膜电阻; Tolerance: ±1%; Power(Watts): 100mW; Temperature Coefficient: ±100ppm/℃; Overload Voltage (Max): 75V; Operating Temperature Range: -55℃~+155℃
R9 R15 R21 = 0603WAF5491T5E: 电阻类型:厚膜电阻;阻值:5.49kΩ;精度:±1%;功率:100mW;; LCSC Part Name: 5.49kΩ ±1% 100mW; Supplier Part: C23069; Manufacturer: UNI-ROYAL(厚声); Supplier Footprint: 0603; JLCPCB Part Class: Extended Part; Datasheet: https://atta.szlcsc.com/upload/public/pdf/source/20200306/C422600_1E6D84923E4A46A82E41ADD87F860B5C.pdf; Supplier: LCSC; Type: 厚膜电阻; Tolerance: ±1%; Power(Watts): 100mW; Temperature Coefficient: ±100ppm/℃; Overload Voltage (Max): 75V; Operating Temperature Range: -55℃~+155℃
S1 S2 = MT-0-102-A101-M200-RS: 额定电流:5A;额定电压(AC):125V;电路结构:单刀双掷;机械寿命:-;安装方式:直插;; LCSC Part Name: 小型钮子三脚二档 二件套 含配件; Supplier Part: C1788492; Manufacturer: YUEN FUNG(源丰); Supplier Footprint: 插件; JLCPCB Part Class: 扩展库; Datasheet: https://atta.szlcsc.com/upload/public/pdf/source/20230720/8E5C36EFDF374AE4FF4AC09DB233CE0E.pdf; Supplier: LCSC; Contact Current: 5A; Voltage Rating (AC): 125V; Circuit: 单刀双掷; Actuator Type: 圆柱钮柄; Pin Style: 焊片; Mounting Style: 直插; Operating Temperature: -25℃~+85℃; Switch Length: 13mm; Switch Width: 8mm; Switch Height: 28.6mm
U1 = LM2596S-5.0_C347421: 功能类型:降压型;输出类型:固定;输入电压:40V;输出电压:5V;输出电流(最大值):3A;; Supplier Part: C347421; Manufacturer: UMW(友台半导体); Supplier Footprint: TO-263-5; JLCPCB Part Class: 扩展库; Datasheet: https://atta.szlcsc.com/upload/public/pdf/source/20230506/0930E65C3A8B7B120C8A4D8E5A8AC327.pdf; Supplier: LCSC; Function: 降压型; Output Type: 固定; Input Voltage: 40V; Output Voltage: 5V; Output Current (Max): 3A; Switching Frequency: 150kHz; Operating Temperature: -40℃~+125℃@(TA); Synchronous Rectification: 否; Number of Outputs: 1; Topology: 降压式; Switch tube (built-in/external): 内置
U2-U4 = MP2225: DC-DC芯片
U5-U7 = RT9013-33GB: 输出类型:固定;最大输入电压:5.5V;输出电压:3.3V;最大输出电流:500mA;电源纹波抑制比(PSRR):50dB@(10kHz);输出极性:正极;; LCSC Part Name: 输入5.5V 输出3.3V 500mA; Supplier Part: C47773; Manufacturer: RICHTEK(立锜); Supplier Footprint: SOT-23-5; JLCPCB Part Class: 扩展库; Datasheet: https://atta.szlcsc.com/upload/public/pdf/source/20150504/1457707282459.pdf; Supplier: LCSC; Output Type: 固定; Maximum Input Voltage: 5.5V; Output Voltage: 3.3V; MAX Output Current: 500mA; Power Supply Rejection Ratio (PSRR): 50dB@(10kHz); Dropout Voltage: 400mV@(500mA); standby current: 50uA; Operating Temperature: -40℃~+85℃; Output Polarity: 正极; Number of Outputs: 1
U8 = RY2121: Supplier Part: C2887853; Manufacturer: RYCHiP(蕊源); Supplier Footprint: SOT-23-5; JLCPCB Part Class: 扩展库; Datasheet: https://atta.szlcsc.com/upload/public/pdf/source/20210826/0463BBCFA36A5F74D180B73203B8A119.pdf; Supplier: LCSC

## Nets
3V3: C26.1 C27.2 C39.2 F1.1 H2.2 H3.2 H4.2 H5.2 H6.1 R23.1 R26.2 U5.5(VOUT) U9.14(VCC) U10.14(VCC)
3V3_CSI: C30.1 C31.2 H1.1 U6.5(VOUT)
3V3_TFT: C34.1 C35.2 CN2.5 CN3.5 CN4.5 S2.2 U7.5(VOUT)
+5V: C14.1 C15.1 C16.1 D7.2(A) D8.2(A) D9.2(A) L8.2 R14.1 R16.2 U8.5(IN)
+5V_CORE: C2.1 C37.2 C38.2 L4.2 R4.1 U1.4(FB) U11.5(5V) U11.6(5V)
+5V_EXT: BUZZER1.1(+) CN1.1 CN2.1 CN3.1 CN4.1 D10.1(C) H9.7 U8.1(OUT)
+8V_1: C7.1 C8.1 C9.1 H10.2 H11.2 H12.2 L10.2 R8.1 R10.2
+8V_2: C21.1 C22.1 C23.1 D11.2(K) H13.2 H14.2 H15.2 K1.2 K1.4 L9.2 R20.1 R22.2
GND: C1.2 C2.2 C3.2 C4.1 C5.2 C8.2 C9.2 C10.2 C11.1 C12.2 C15.2 C16.2 C17.2 C18.1 C19.2 C22.2 C23.2 C24.2 C25.1 C26.2 C27.1 C28.2 C29.1 C32.2 C33.1 C34.2 C35.1 C36.1 C37.1 C38.1 C39.1 CN1.2 CN2.2 CN3.2 CN4.2 D2.1(A) F1.12 H2.1 H3.1 H4.1 H5.1 H6.2 H7.3 H8.3 H9.5 H9.6 H10.3 H11.3 H12.3 H13.3 H14.3 H15.3 J4.2 L1.2 L2.2 L3.2 L7.1 LED2.1(K) LED3.1(-) LED4.1(-) LED5.1(-) LED6.1(-) LED7.1(-) LED8.1(-) Q2.2(E) Q3.2(E) R6.1 R9.1 R12.1 R15.1 R18.1 R21.1 R25.1 R28.2 R29.2 R30.2 R31.2 R32.2 R33.2 R34.2 R38.2 U1.3(GND) U1.5(ON#/OFF) U1.6(EP) U2.1(AGND) U2.4(GND) U3.1(AGND) U3.4(GND) U4.1(AGND) U4.4(GND) U5.2(GND) U6.2(GND) U7.2(GND) U8.2(GND) U9.1(1OE#) U9.4(2OE#) U9.7(GND) U9.10(3OE#) U9.13(4OE#) U10.1(1OE#) U10.4(2OE#) U10.7(GND) U10.10(3OE#) U10.13(4OE#) U11.1(GND) U11.2(GND)
GND_CSI: C30.2 C31.1 H1.3 H1.13 L7.2
GNDBAT: J1.1(-) J2.2 J3.2 L1.1 L2.1 L3.1 LED1.1(K) R3.2
VCCBAT: D3.1(A) D4.1(A) D5.1(A) D6.1(A) J2.1 J3.1 Q1.2(D) R1.1
B0: F1.11 U11.23(B0)
B1: F1.10 U11.24(B1)
B2: F1.9 U11.25(B2)
B3: F1.7 U11.26(B3)
B9: CN1.3 U11.49(B9)
B10: CN1.4 U11.48(B10)
B11: R33.1 U10.2(1A) U11.47(B11)
B11_A: H15.1 U10.3(1Y)
B12: CN2.4 U11.29(B12)
B13: CN2.3 U11.27(B13)
B14: F1.4 U11.30(B14)
B15: CN1.6 U11.28(B15)
B16: H4.3 U11.32(B16)
B17: H4.4 U11.31(B17)
B18: CN3.4 U11.34(B18)
B19: CN3.3 U11.33(B19)
B20: H1.15 U11.36(B20)
B21: R27.1 U11.35(B21)
B22: H1.5 U11.38(B22)
B23: F1.3 U11.37(B23)
B24: H1.2 U11.40(B24)
B25: H1.4 U11.39(B25)
B26: H1.6 U11.42(B26)
B27: H1.8 U11.41(B27)
B28: H1.10 U11.46(B28)
B29: H1.12 U11.45(B29)
B30: H1.14 U11.43(B30)
B31: H1.16 U11.44(B31)
C0: H3.3 U11.82(C0)
C1: H3.4 U11.79(C1)
C2: H2.3 U11.80(C2)
C3: H5.3 U11.77(C3)
C6: R32.1 U10.5(2A) U11.76(C6)
C6_A: H14.1 U10.6(2Y)
C11: H8.1 U11.69(C11)
C16: CN4.4 U11.66(C16)
C17: CN4.3 U11.63(C17)
C18: F1.6 U11.64(C18)
C19: F1.8 U11.61(C19)
C20: H6.6 U11.62(C20)
C21: H6.5 U11.59(C21)
C22: H6.4 U11.60(C22)
C23: H6.3 U11.57(C23)
C24: H2.4 U11.58(C24)
C25: H5.4 U11.55(C25)
C26: F1.2 R26.1 U11.56(C26)
C27: H7.5 U11.53(C27)
C28: H1.9 U11.54(C28)
C29: H1.11 U11.51(C29)
C30: H7.1 U11.52(C30)
C31: H8.5 U11.50(C31)
CR: C36.2 R35.2 R36.2 U5.3(EN) U6.3(EN) U7.3(EN) U8.4(EN)
D0: R28.1 U9.5(2A) U11.14(D0)
D0_A: H10.1 U9.6(2Y)
D1: R31.1 U9.9(3A) U11.13(D1)
D1_A: H11.1 U9.8(3Y)
D2: R29.1 U9.2(1A) U11.12(D2)
D2_A: H12.1 U9.3(1Y)
D3: R30.1 U9.12(4A) U11.11(D3)
D3_A: H13.1 U9.11(4Y)
D4: CN1.5 U11.10(D4)
D12: H8.2 U11.15(D12)
D13: H8.6 U11.16(D13)
D14: H7.6 U11.17(D14)
D15: H7.2 U11.18(D15)
D16: H9.1 U11.19(D16)
D17: H9.3 U11.20(D17)
D26: H9.4 U11.84(D26)
D27: R34.1 U10.12(4A) U11.81(D27)
D27_A: R37.1 U10.11(4Y)
NSLEEP: H7.4 H8.4 R24.2 S2.3
$1N429: D1.1(K) R2.1 S1.3
$1N430: D1.2(A) R3.1 S1.1
$1N431: J1.2(+) Q1.3(S) R2.2
$1N432: Q1.1(G) S1.2
$1N517: LED1.2(A) R1.2
$1N6580: C24.1 C25.2 D7.1(C) U5.1(VIN)
$1N6622: LED6.2(+) R23.2
$1N7021: C28.1 C29.2 D8.1(C) U6.1(VIN)
$1N10122: LED7.2(+) R24.1
$1N19893: D2.2(K) L4.1 U1.2(OUT)
$1N22092: LED2.2(A) R4.2
$1N25035: C1.1 D3.2(K) U1.1(VIN)
$1N25688: C13.1 L8.1 U2.3(SW)
$1N25690: R11.1 U2.6(EN)
$1N25691: C12.1 R12.2 U2.7(VCC)
$1N25693: C14.2 R14.2 R15.2 U2.8(FB)
$1N25694: C13.2 R13.2
$1N25695: R13.1 U2.5(BST)
$1N25697: LED4.2(+) R16.1
$1N25841: C10.1 C11.2 D5.2(K) R11.2 U2.2(IN)
$1N26496: C20.1 L9.1 U4.3(SW)
$1N26497: R17.1 U4.6(EN)
$1N26498: C19.1 R18.2 U4.7(VCC)
$1N26500: C21.2 R20.2 R21.2 U4.8(FB)
$1N26501: C20.2 R19.2
$1N26502: R19.1 U4.5(BST)
$1N26503: LED5.2(+) R22.1
$1N26528: C17.1 C18.2 D6.2(K) R17.2 U4.2(IN)
$1N27190: C6.1 L10.1 U3.3(SW)
$1N27191: R5.1 U3.6(EN)
$1N27192: C5.1 R6.2 U3.7(VCC)
$1N27194: C7.2 R8.2 R9.2 U3.8(FB)
$1N27195: C6.2 R7.2
$1N27196: R7.1 U3.5(BST)
$1N27197: LED3.2(+) R10.1
$1N27244: C3.1 C4.2 D4.2(K) R5.2 U3.2(IN)
$1N27596: C32.1 C33.2 D9.1(C) U7.1(VIN)
$1N27726: R25.2 U8.3(SET)
$2N831: R35.1 R36.1 U11.9(CR)
$2N3111: Q2.1(B) R27.2
$2N3113: BUZZER1.2 D10.2(A) Q2.3(C)
$2N15445: Q3.1(B) R37.2 R38.1
$2N16532: D11.1(A) K1.1 Q3.3(C)
$2N16600: LED8.2(+) R39.2
$2N16605: J4.1 K1.3 R39.1

Not connected (* = marked no-connect by the designer): B1 1(M3)*; B2 1(M3)*; B3 1(M3)*; B4 1(M3)*; B5 1(M3)*; B6 1(M3)*; F1 5* 13* 14*; H1 7*; H2 5* 6*; H3 5* 6*; H4 5* 6*; H5 5* 6*; H6 7* 8*; H9 2* 8*; S2 1*; U5 4(NC)*; U6 4(NC)*; U7 4(NC)*; U10 8(3Y)* 9(3A)*; U11 3(3V3)* 4(3V3)* 7(OF)* 8(WU)* 21(2DP)* 22(2DN)* 65(C15)* 67(C13)* 68(C14)* 70(C12)* 71(C9)* 72(C10)* 73(C7)* 74(C8)* 75(C5)* 78(C4)* 83(GND)*

## Notes on the sheets
sheet 1
- 电源输入
- 5V核心板
- 舵机
- 5V_外设
- 舵机
- 3V3
- 3V3_CSI
- 3V3_TFT
- 电机
sheet 2
- 摄像头接口
- 编码器接口
- 电机接口
- 核心板
- LF
- RF
- IMU660RA
- LB
- RB
- 蓝牙接口
- 电气隔离
- 调参接口
- 测距
- OPENART
- 蜂鸣器
- 电气隔离
- 舵机接口
